# EAGLE schematic Resistor_Resistor (EAGLE 8.3.0), part 15 of 43
## Parts (continued)
R20178  10K  RESISTOR_0201  [0201]
R20179  10K  RESISTOR_0201  [0201]
R20180  10K  RESISTOR_0201  [0201]
R20181  10K  RESISTOR_0201  [0201]
R20182  10K  RESISTOR_0201  [0201]
R20183  10K  RESISTOR_0201  [0201]
R20184  10K  RESISTOR_0201  [0201]
R20185  10K  RESISTOR_0201  [0201]
R20186  10K  RESISTOR_0201  [0201]
R20187  10K  RESISTOR_0201  [0201]
R20188  10K  RESISTOR_0201  [0201]
R20189  10K  RESISTOR_0201  [0201]
R20190  10K  RESISTOR_0201  [0201]
R20191  10K  RESISTOR_0201  [0201]
R20192  10K  RESISTOR_0201  [0201]
R20193  10K  RESISTOR_0201  [0201]
R20194  10K  RESISTOR_0201  [0201]
R20195  10K  RESISTOR_0201  [0201]
R20196  10K  RESISTOR_0201  [0201]
R20197  10K  RESISTOR_0201  [0201]
R20198  10K  RESISTOR_0201  [0201]
R20199  10K  RESISTOR_0201  [0201]
R20200  10K  RESISTOR_0201  [0201]
R20201  10K  RESISTOR_0201  [0201]
R20202  10K  RESISTOR_0201  [0201]
R20203  10K  RESISTOR_0201  [0201]
R20204  10K  RESISTOR_0201  [0201]
R20205  10K  RESISTOR_0201  [0201]
R20206  10K  RESISTOR_0201  [0201]
R20207  10K  RESISTOR_0201  [0201]
R20208  10K  RESISTOR_0201  [0201]
R20209  10K  RESISTOR_0201  [0201]
R20210  10K  RESISTOR_0201  [0201]
R20211  10K  RESISTOR_0201  [0201]
R20212  10K  RESISTOR_0201  [0201]
R20213  10K  RESISTOR_0201  [0201]
R20214  10K  RESISTOR_0201  [0201]
R20215  10K  RESISTOR_0201  [0201]
R20216  10K  RESISTOR_0201  [0201]
R20217  10K  RESISTOR_0201  [0201]
R20218  10K  RESISTOR_0201  [0201]
R20219  10K  RESISTOR_0201  [0201]
R20220  10K  RESISTOR_0201  [0201]
R20221  10K  RESISTOR_0201  [0201]
R20222  10K  RESISTOR_0201  [0201]
R20223  10K  RESISTOR_0201  [0201]
R20224  10K  RESISTOR_0201  [0201]
R20225  10K  RESISTOR_0201  [0201]
R20226  10K  RESISTOR_0201  [0201]
R20227  10K  RESISTOR_0201  [0201]
R20228  10K  RESISTOR_0201  [0201]
R20229  10K  RESISTOR_0201  [0201]
R20230  10K  RESISTOR_0201  [0201]
R20231  10K  RESISTOR_0201  [0201]
R20232  10K  RESISTOR_0201  [0201]
R20233  10K  RESISTOR_0201  [0201]
R20234  10K  RESISTOR_0201  [0201]
R20235  10K  RESISTOR_0201  [0201]
R20236  10K  RESISTOR_0201  [0201]
R20237  10K  RESISTOR_0201  [0201]
R20238  10K  RESISTOR_0201  [0201]
R20239  10K  RESISTOR_0201  [0201]
R20240  10K  RESISTOR_0201  [0201]
R20241  10K  RESISTOR_0201  [0201]
R20242  10K  RESISTOR_0201  [0201]
R20243  10K  RESISTOR_0201  [0201]
R20244  10K  RESISTOR_0201  [0201]
R20245  10K  RESISTOR_0201  [0201]
R20246  10K  RESISTOR_0201  [0201]
R20247  10K  RESISTOR_0201  [0201]
R20248  10K  RESISTOR_0201  [0201]
R20249  10K  RESISTOR_0201  [0201]
R20250  10K  RESISTOR_0201  [0201]
R20251  10K  RESISTOR_0201  [0201]
R20252  10K  RESISTOR_0201  [0201]
R20253  10K  RESISTOR_0201  [0201]
R20254  10K  RESISTOR_0201  [0201]
R20255  10K  RESISTOR_0201  [0201]
R20256  10K  RESISTOR_0201  [0201]
R20257  10K  RESISTOR_0201  [0201]
R20258  10K  RESISTOR_0201  [0201]
R20259  10K  RESISTOR_0201  [0201]
R20260  10K  RESISTOR_0201  [0201]
R20261  10K  RESISTOR_0201  [0201]
R20262  10K  RESISTOR_0201  [0201]
R20263  10K  RESISTOR_0201  [0201]
R20264  10K  RESISTOR_0201  [0201]
R20265  10K  RESISTOR_0201  [0201]
R20266  10K  RESISTOR_0201  [0201]
R20267  10K  RESISTOR_0201  [0201]
R20268  10K  RESISTOR_0201  [0201]
R20269  10K  RESISTOR_0201  [0201]
R20270  10K  RESISTOR_0201  [0201]
R20271  10K  RESISTOR_0201  [0201]
R20272  10K  RESISTOR_0201  [0201]
R20273  10K  RESISTOR_0201  [0201]
R20274  10K  RESISTOR_0201  [0201]
R20275  10K  RESISTOR_0201  [0201]
R20276  10K  RESISTOR_0201  [0201]
R20277  10K  RESISTOR_0201  [0201]
R20278  10K  RESISTOR_0201  [0201]
R20279  10K  RESISTOR_0201  [0201]
R20280  10K  RESISTOR_0201  [0201]
R20281  10K  RESISTOR_0201  [0201]
R20282  10K  RESISTOR_0201  [0201]
R20283  10K  RESISTOR_0201  [0201]
R20284  10K  RESISTOR_0201  [0201]
R20285  10K  RESISTOR_0201  [0201]
R20286  10K  RESISTOR_0201  [0201]
R20287  10K  RESISTOR_0201  [0201]
R20288  10K  RESISTOR_0201  [0201]
R20289  10K  RESISTOR_0201  [0201]
R20290  10K  RESISTOR_0201  [0201]
R20291  10K  RESISTOR_0201  [0201]
R20292  10K  RESISTOR_0201  [0201]
R20293  10K  RESISTOR_0201  [0201]
R20294  10K  RESISTOR_0201  [0201]
R20295  10K  RESISTOR_0201  [0201]
R20296  10K  RESISTOR_0201  [0201]
R20297  10K  RESISTOR_0201  [0201]
R20298  10K  RESISTOR_0201  [0201]
R20299  10K  RESISTOR_0201  [0201]
R20300  10K  RESISTOR_0201  [0201]
R20301  10K  RESISTOR_0201  [0201]
R20302  10K  RESISTOR_0201  [0201]
R20303  10K  RESISTOR_0201  [0201]
R20304  10K  RESISTOR_0201  [0201]
R20305  10K  RESISTOR_0201  [0201]
R20306  10K  RESISTOR_0201  [0201]
R20307  10K  RESISTOR_0201  [0201]
R20308  10K  RESISTOR_0201  [0201]
R20309  10K  RESISTOR_0201  [0201]
R20310  10K  RESISTOR_0201  [0201]
R20311  10K  RESISTOR_0201  [0201]
R20312  10K  RESISTOR_0201  [0201]
R20313  10K  RESISTOR_0201  [0201]
R20314  10K  RESISTOR_0201  [0201]
R20315  10K  RESISTOR_0201  [0201]
R20316  10K  RESISTOR_0201  [0201]
R20317  10K  RESISTOR_0201  [0201]
R20318  10K  RESISTOR_0201  [0201]
R20319  10K  RESISTOR_0201  [0201]
R20320  10K  RESISTOR_0201  [0201]
R20321  10K  RESISTOR_0201  [0201]
R20322  10K  RESISTOR_0201  [0201]
R20323  10K  RESISTOR_0201  [0201]
R20324  10K  RESISTOR_0201  [0201]
R20325  10K  RESISTOR_0201  [0201]
R20326  10K  RESISTOR_0201  [0201]
R20327  10K  RESISTOR_0201  [0201]
R20328  10K  RESISTOR_0201  [0201]
R20329  10K  RESISTOR_0201  [0201]
R20330  10K  RESISTOR_0201  [0201]
R20331  10K  RESISTOR_0201  [0201]
R20332  10K  RESISTOR_0201  [0201]
R20333  10K  RESISTOR_0201  [0201]
R20334  10K  RESISTOR_0201  [0201]
R20335  10K  RESISTOR_0201  [0201]
R20336  10K  RESISTOR_0201  [0201]
R20337  10K  RESISTOR_0201  [0201]
R20338  10K  RESISTOR_0201  [0201]
R20339  10K  RESISTOR_0201  [0201]
R20340  10K  RESISTOR_0201  [0201]
R20341  10K  RESISTOR_0201  [0201]
R20342  10K  RESISTOR_0201  [0201]
R20343  10K  RESISTOR_0201  [0201]
R20344  10K  RESISTOR_0201  [0201]
R20345  10K  RESISTOR_0201  [0201]
R20346  10K  RESISTOR_0201  [0201]
R20347  10K  RESISTOR_0201  [0201]
R20348  10K  RESISTOR_0201  [0201]
R20349  10K  RESISTOR_0201  [0201]
R20350  10K  RESISTOR_0201  [0201]
R20351  10K  RESISTOR_0201  [0201]
R20352  10K  RESISTOR_0201  [0201]
R20353  10K  RESISTOR_0201  [0201]
R20354  10K  RESISTOR_0201  [0201]
R20355  10K  RESISTOR_0201  [0201]
R20356  10K  RESISTOR_0201  [0201]
R20357  10K  RESISTOR_0201  [0201]
R20358  10K  RESISTOR_0201  [0201]
R20359  10K  RESISTOR_0201  [0201]
R20360  10K  RESISTOR_0201  [0201]
R20361  10K  RESISTOR_0201  [0201]
R20362  10K  RESISTOR_0201  [0201]
R20363  10K  RESISTOR_0201  [0201]
R20364  10K  RESISTOR_0201  [0201]
R20365  10K  RESISTOR_0201  [0201]
R20366  10K  RESISTOR_0201  [0201]
R20367  10K  RESISTOR_0201  [0201]
R20368  10K  RESISTOR_0201  [0201]
R20369  10K  RESISTOR_0201  [0201]
R20370  10K  RESISTOR_0201  [0201]
R20371  10K  RESISTOR_0201  [0201]
R20372  10K  RESISTOR_0201  [0201]
R20373  10K  RESISTOR_0201  [0201]
R20374  10K  RESISTOR_0201  [0201]
R20375  10K  RESISTOR_0201  [0201]
R20376  10K  RESISTOR_0201  [0201]
R20377  10K  RESISTOR_0201  [0201]
R20378  10K  RESISTOR_0201  [0201]
R20379  10K  RESISTOR_0201  [0201]
R20380  10K  RESISTOR_0201  [0201]
R20381  10K  RESISTOR_0201  [0201]
R20382  10K  RESISTOR_0201  [0201]
R20383  10K  RESISTOR_0201  [0201]
R20384  10K  RESISTOR_0201  [0201]
R20385  10K  RESISTOR_0201  [0201]
R20386  10K  RESISTOR_0201  [0201]
R20387  10K  RESISTOR_0201  [0201]
R20388  10K  RESISTOR_0201  [0201]
R20389  10K  RESISTOR_0201  [0201]
R20390  10K  RESISTOR_0201  [0201]
R20391  10K  RESISTOR_0201  [0201]
R20392  10K  RESISTOR_0201  [0201]
R20393  10K  RESISTOR_0201  [0201]
R20394  10K  RESISTOR_0201  [0201]
R20395  10K  RESISTOR_0201  [0201]
R20396  10K  RESISTOR_0201  [0201]
R20397  10K  RESISTOR_0201  [0201]
R20398  10K  RESISTOR_0201  [0201]
R20399  10K  RESISTOR_0201  [0201]
R20400  10K  RESISTOR_0201  [0201]
R20401  10K  RESISTOR_0201  [0201]
R20402  10K  RESISTOR_0201  [0201]
R20403  10K  RESISTOR_0201  [0201]
R20404  10K  RESISTOR_0201  [0201]
R20405  10K  RESISTOR_0201  [0201]
R20406  10K  RESISTOR_0201  [0201]
R20407  10K  RESISTOR_0201  [0201]
R20408  10K  RESISTOR_0201  [0201]
R20409  10K  RESISTOR_0201  [0201]
R20410  10K  RESISTOR_0201  [0201]
R20411  10K  RESISTOR_0201  [0201]
R20412  10K  RESISTOR_0201  [0201]
R20413  10K  RESISTOR_0201  [0201]
R20414  10K  RESISTOR_0201  [0201]
R20415  10K  RESISTOR_0201  [0201]
R20416  10K  RESISTOR_0201  [0201]
R20417  10K  RESISTOR_0201  [0201]
R20418  10K  RESISTOR_0201  [0201]
R20419  10K  RESISTOR_0201  [0201]
R20420  10K  RESISTOR_0201  [0201]
R20421  10K  RESISTOR_0201  [0201]
R20422  10K  RESISTOR_0201  [0201]
R20423  10K  RESISTOR_0201  [0201]
R20424  10K  RESISTOR_0201  [0201]
R20425  10K  RESISTOR_0201  [0201]
R20426  10K  RESISTOR_0201  [0201]
R20427  10K  RESISTOR_0201  [0201]
R20428  10K  RESISTOR_0201  [0201]
R20429  10K  RESISTOR_0201  [0201]
R20430  10K  RESISTOR_0201  [0201]
R20431  10K  RESISTOR_0201  [0201]
R20432  10K  RESISTOR_0201  [0201]
R20433  10K  RESISTOR_0201  [0201]
R20434  10K  RESISTOR_0201  [0201]
R20435  10K  RESISTOR_0201  [0201]
R20436  10K  RESISTOR_0201  [0201]
R20437  10K  RESISTOR_0201  [0201]
R20438  10K  RESISTOR_0201  [0201]
R20439  10K  RESISTOR_0201  [0201]
R20440  10K  RESISTOR_0201  [0201]
R20441  10K  RESISTOR_0201  [0201]
R20442  10K  RESISTOR_0201  [0201]
R20443  10K  RESISTOR_0201  [0201]
R20444  10K  RESISTOR_0201  [0201]
R20445  10K  RESISTOR_0201  [0201]
R20446  10K  RESISTOR_0201  [0201]
R20447  10K  RESISTOR_0201  [0201]
R20448  10K  RESISTOR_0201  [0201]
R20449  10K  RESISTOR_0201  [0201]
R20450  10K  RESISTOR_0201  [0201]
R20451  10K  RESISTOR_0201  [0201]
R20452  10K  RESISTOR_0201  [0201]
R20453  10K  RESISTOR_0201  [0201]
R20454  10K  RESISTOR_0201  [0201]
R20455  10K  RESISTOR_0201  [0201]
R20456  10K  RESISTOR_0201  [0201]
R20457  10K  RESISTOR_0201  [0201]
R20458  10K  RESISTOR_0201  [0201]
R20459  10K  RESISTOR_0201  [0201]
R20460  10K  RESISTOR_0201  [0201]
R20461  10K  RESISTOR_0201  [0201]
R20462  10K  RESISTOR_0201  [0201]
R20463  10K  RESISTOR_0201  [0201]
R20464  10K  RESISTOR_0201  [0201]
R20465  10K  RESISTOR_0201  [0201]
R20466  10K  RESISTOR_0201  [0201]
R20467  10K  RESISTOR_0201  [0201]
R20468  10K  RESISTOR_0201  [0201]
R20469  10K  RESISTOR_0201  [0201]
R20470  10K  RESISTOR_0201  [0201]
R20471  10K  RESISTOR_0201  [0201]
R20472  10K  RESISTOR_0201  [0201]
R20473  10K  RESISTOR_0201  [0201]
R20474  10K  RESISTOR_0201  [0201]
R20475  10K  RESISTOR_0201  [0201]
R20476  10K  RESISTOR_0201  [0201]
R20477  10K  RESISTOR_0201  [0201]
R20478  10K  RESISTOR_0201  [0201]
R20479  10K  RESISTOR_0201  [0201]
R20480  10K  RESISTOR_0201  [0201]
R20481  10K  RESISTOR_0201  [0201]
R20482  10K  RESISTOR_0201  [0201]
R20483  10K  RESISTOR_0201  [0201]
R20484  10K  RESISTOR_0201  [0201]
R20485  10K  RESISTOR_0201  [0201]
R20486  10K  RESISTOR_0201  [0201]
R20487  10K  RESISTOR_0201  [0201]
R20488  10K  RESISTOR_0201  [0201]
R20489  10K  RESISTOR_0201  [0201]
R20490  10K  RESISTOR_0201  [0201]
R20491  10K  RESISTOR_0201  [0201]
R20492  10K  RESISTOR_0201  [0201]
R20493  10K  RESISTOR_0201  [0201]
R20494  10K  RESISTOR_0201  [0201]
R20495  10K  RESISTOR_0201  [0201]
R20496  10K  RESISTOR_0201  [0201]
R20497  10K  RESISTOR_0201  [0201]
R20498  10K  RESISTOR_0201  [0201]
R20499  10K  RESISTOR_0201  [0201]
R20500  10K  RESISTOR_0201  [0201]
R20501  10K  RESISTOR_0201  [0201]
R20502  10K  RESISTOR_0201  [0201]
R20503  10K  RESISTOR_0201  [0201]
R20504  10K  RESISTOR_0201  [0201]
R20505  10K  RESISTOR_0201  [0201]
R20506  10K  RESISTOR_0201  [0201]
R20507  10K  RESISTOR_0201  [0201]
R20508  10K  RESISTOR_0201  [0201]
R20509  10K  RESISTOR_0201  [0201]
R20510  10K  RESISTOR_0201  [0201]
R20511  10K  RESISTOR_0201  [0201]
R20512  10K  RESISTOR_0201  [0201]
R20513  10K  RESISTOR_0201  [0201]
R20514  10K  RESISTOR_0201  [0201]
R20515  10K  RESISTOR_0201  [0201]
R20516  10K  RESISTOR_0201  [0201]
R20517  10K  RESISTOR_0201  [0201]
R20518  10K  RESISTOR_0201  [0201]
R20519  10K  RESISTOR_0201  [0201]
R20520  10K  RESISTOR_0201  [0201]
R20521  10K  RESISTOR_0201  [0201]
R20522  10K  RESISTOR_0201  [0201]
R20523  10K  RESISTOR_0201  [0201]
R20524  10K  RESISTOR_0201  [0201]
R20525  10K  RESISTOR_0201  [0201]
R20526  10K  RESISTOR_0201  [0201]
R20527  10K  RESISTOR_0201  [0201]
R20528  10K  RESISTOR_0201  [0201]
R20529  10K  RESISTOR_0201  [0201]
R20530  10K  RESISTOR_0201  [0201]
R20531  10K  RESISTOR_0201  [0201]
R20532  10K  RESISTOR_0201  [0201]
R20533  10K  RESISTOR_0201  [0201]
R20534  10K  RESISTOR_0201  [0201]
R20535  10K  RESISTOR_0201  [0201]
R20536  10K  RESISTOR_0201  [0201]
R20537  10K  RESISTOR_0201  [0201]
R20538  10K  RESISTOR_0201  [0201]
R20539  10K  RESISTOR_0201  [0201]
R20540  10K  RESISTOR_0201  [0201]
R20541  10K  RESISTOR_0201  [0201]
R20542  10K  RESISTOR_0201  [0201]
R20543  10K  RESISTOR_0201  [0201]
R20544  10K  RESISTOR_0201  [0201]
R20545  10K  RESISTOR_0201  [0201]
R20546  10K  RESISTOR_0201  [0201]
R20547  10K  RESISTOR_0201  [0201]
R20548  10K  RESISTOR_0201  [0201]
R20549  10K  RESISTOR_0201  [0201]
R20550  10K  RESISTOR_0201  [0201]
R20551  10K  RESISTOR_0201  [0201]
R20552  10K  RESISTOR_0201  [0201]
R20553  10K  RESISTOR_0201  [0201]
R20554  10K  RESISTOR_0201  [0201]
R20555  10K  RESISTOR_0201  [0201]
R20556  10K  RESISTOR_0201  [0201]
R20557  10K  RESISTOR_0201  [0201]
R20558  10K  RESISTOR_0201  [0201]
R20559  10K  RESISTOR_0201  [0201]
R20560  10K  RESISTOR_0201  [0201]
R20561  10K  RESISTOR_0201  [0201]
R20562  10K  RESISTOR_0201  [0201]
R20563  10K  RESISTOR_0201  [0201]
R20564  10K  RESISTOR_0201  [0201]
R20565  10K  RESISTOR_0201  [0201]
R20566  10K  RESISTOR_0201  [0201]
R20567  10K  RESISTOR_0201  [0201]
R20568  10K  RESISTOR_0201  [0201]
R20569  10K  RESISTOR_0201  [0201]
R20570  10K  RESISTOR_0201  [0201]
R20571  10K  RESISTOR_0201  [0201]
R20572  10K  RESISTOR_0201  [0201]
R20573  10K  RESISTOR_0201  [0201]
R20574  10K  RESISTOR_0201  [0201]
R20575  10K  RESISTOR_0201  [0201]
R20576  10K  RESISTOR_0201  [0201]
R20577  10K  RESISTOR_0201  [0201]
R20578  10K  RESISTOR_0201  [0201]
R20579  10K  RESISTOR_0201  [0201]
R20580  10K  RESISTOR_0201  [0201]
R20581  10K  RESISTOR_0201  [0201]
R20582  10K  RESISTOR_0201  [0201]
R20583  10K  RESISTOR_0201  [0201]
R20584  10K  RESISTOR_0201  [0201]
R20585  10K  RESISTOR_0201  [0201]
R20586  10K  RESISTOR_0201  [0201]
R20587  10K  RESISTOR_0201  [0201]
R20588  10K  RESISTOR_0201  [0201]
R20589  10K  RESISTOR_0201  [0201]
R20590  10K  RESISTOR_0201  [0201]
R20591  10K  RESISTOR_0201  [0201]
R20592  10K  RESISTOR_0201  [0201]
R20593  10K  RESISTOR_0201  [0201]
R20594  10K  RESISTOR_0201  [0201]
R20595  10K  RESISTOR_0201  [0201]
R20596  10K  RESISTOR_0201  [0201]
R20597  10K  RESISTOR_0201  [0201]
R20598  10K  RESISTOR_0201  [0201]
R20599  10K  RESISTOR_0201  [0201]
R20600  10K  RESISTOR_0201  [0201]
R20601  10K  RESISTOR_0201  [0201]
R20602  10K  RESISTOR_0201  [0201]
R20603  10K  RESISTOR_0201  [0201]
R20604  10K  RESISTOR_0201  [0201]
R20605  10K  RESISTOR_0201  [0201]
R20606  10K  RESISTOR_0201  [0201]
R20607  10K  RESISTOR_0201  [0201]
R20608  10K  RESISTOR_0201  [0201]
R20609  10K  RESISTOR_0201  [0201]
R20610  10K  RESISTOR_0201  [0201]
R20611  10K  RESISTOR_0201  [0201]
R20612  10K  RESISTOR_0201  [0201]
R20613  10K  RESISTOR_0201  [0201]
R20614  10K  RESISTOR_0201  [0201]
R20615  10K  RESISTOR_0201  [0201]
R20616  10K  RESISTOR_0201  [0201]
R20617  10K  RESISTOR_0201  [0201]
R20618  10K  RESISTOR_0201  [0201]
R20619  10K  RESISTOR_0201  [0201]
R20620  10K  RESISTOR_0201  [0201]
R20621  10K  RESISTOR_0201  [0201]
R20622  10K  RESISTOR_0201  [0201]
R20623  10K  RESISTOR_0201  [0201]
R20624  10K  RESISTOR_0201  [0201]
R20625  10K  RESISTOR_0201  [0201]
R20626  10K  RESISTOR_0201  [0201]
R20627  10K  RESISTOR_0201  [0201]
R20628  10K  RESISTOR_0201  [0201]
R20629  10K  RESISTOR_0201  [0201]
R20630  10K  RESISTOR_0201  [0201]
R20631  10K  RESISTOR_0201  [0201]
R20632  10K  RESISTOR_0201  [0201]
R20633  10K  RESISTOR_0201  [0201]
R20634  10K  RESISTOR_0201  [0201]
R20635  10K  RESISTOR_0201  [0201]
R20636  10K  RESISTOR_0201  [0201]
R20637  10K  RESISTOR_0201  [0201]
R20638  10K  RESISTOR_0201  [0201]
R20639  10K  RESISTOR_0201  [0201]
R20640  10K  RESISTOR_0201  [0201]
R20641  10K  RESISTOR_0201  [0201]
R20642  10K  RESISTOR_0201  [0201]
R20643  10K  RESISTOR_0201  [0201]
R20644  10K  RESISTOR_0201  [0201]
R20645  10K  RESISTOR_0201  [0201]
R20646  10K  RESISTOR_0201  [0201]
R20647  10K  RESISTOR_0201  [0201]
R20648  10K  RESISTOR_0201  [0201]
R20649  10K  RESISTOR_0201  [0201]
R20650  10K  RESISTOR_0201  [0201]
R20651  10K  RESISTOR_0201  [0201]
R20652  10K  RESISTOR_0201  [0201]
R20653  10K  RESISTOR_0201  [0201]
R20654  10K  RESISTOR_0201  [0201]
R20655  10K  RESISTOR_0201  [0201]
R20656  10K  RESISTOR_0201  [0201]
R20657  10K  RESISTOR_0201  [0201]
R20658  10K  RESISTOR_0201  [0201]
R20659  10K  RESISTOR_0201  [0201]
R20660  10K  RESISTOR_0201  [0201]
R20661  10K  RESISTOR_0201  [0201]
R20662  10K  RESISTOR_0201  [0201]
R20663  10K  RESISTOR_0201  [0201]
R20664  10K  RESISTOR_0201  [0201]
R20665  10K  RESISTOR_0201  [0201]
R20666  10K  RESISTOR_0201  [0201]
R20667  10K  RESISTOR_0201  [0201]
R20668  10K  RESISTOR_0201  [0201]
R20669  10K  RESISTOR_0201  [0201]
R20670  10K  RESISTOR_0201  [0201]
R20671  10K  RESISTOR_0201  [0201]
R20672  10K  RESISTOR_0201  [0201]
R20673  10K  RESISTOR_0201  [0201]
R20674  10K  RESISTOR_0201  [0201]
R20675  10K  RESISTOR_0201  [0201]
R20676  10K  RESISTOR_0201  [0201]
R20677  10K  RESISTOR_0201  [0201]
R20678  10K  RESISTOR_0201  [0201]
R20679  10K  RESISTOR_0201  [0201]
R20680  10K  RESISTOR_0201  [0201]
R20681  10K  RESISTOR_0201  [0201]
R20682  10K  RESISTOR_0201  [0201]
R20683  10K  RESISTOR_0201  [0201]
R20684  10K  RESISTOR_0201  [0201]
R20685  10K  RESISTOR_0201  [0201]
R20686  10K  RESISTOR_0201  [0201]
R20687  10K  RESISTOR_0201  [0201]
R20688  10K  RESISTOR_0201  [0201]
R20689  10K  RESISTOR_0201  [0201]
R20690  10K  RESISTOR_0201  [0201]
R20691  10K  RESISTOR_0201  [0201]
R20692  10K  RESISTOR_0201  [0201]
R20693  10K  RESISTOR_0201  [0201]
R20694  10K  RESISTOR_0201  [0201]
R20695  10K  RESISTOR_0201  [0201]
R20696  10K  RESISTOR_0201  [0201]
R20697  10K  RESISTOR_0201  [0201]
R20698  10K  RESISTOR_0201  [0201]
R20699  10K  RESISTOR_0201  [0201]
R20700  10K  RESISTOR_0201  [0201]
R20701  10K  RESISTOR_0201  [0201]
R20702  10K  RESISTOR_0201  [0201]
R20703  10K  RESISTOR_0201  [0201]
R20704  10K  RESISTOR_0201  [0201]
R20705  10K  RESISTOR_0201  [0201]
R20706  10K  RESISTOR_0201  [0201]
R20707  10K  RESISTOR_0201  [0201]
R20708  10K  RESISTOR_0201  [0201]
R20709  10K  RESISTOR_0201  [0201]
R20710  10K  RESISTOR_0201  [0201]
R20711  10K  RESISTOR_0201  [0201]
R20712  10K  RESISTOR_0201  [0201]
R20713  10K  RESISTOR_0201  [0201]
R20714  10K  RESISTOR_0201  [0201]
R20715  10K  RESISTOR_0201  [0201]
R20716  10K  RESISTOR_0201  [0201]
R20717  10K  RESISTOR_0201  [0201]
R20718  10K  RESISTOR_0201  [0201]
R20719  10K  RESISTOR_0201  [0201]
R20720  10K  RESISTOR_0201  [0201]
R20721  10K  RESISTOR_0201  [0201]
R20722  10K  RESISTOR_0201  [0201]
R20723  10K  RESISTOR_0201  [0201]
R20724  10K  RESISTOR_0201  [0201]
R20725  10K  RESISTOR_0201  [0201]
R20726  10K  RESISTOR_0201  [0201]
R20727  10K  RESISTOR_0201  [0201]
R20728  10K  RESISTOR_0201  [0201]
R20729  10K  RESISTOR_0201  [0201]
R20730  10K  RESISTOR_0201  [0201]
R20731  10K  RESISTOR_0201  [0201]
R20732  10K  RESISTOR_0201  [0201]
R20733  10K  RESISTOR_0201  [0201]
R20734  10K  RESISTOR_0201  [0201]
R20735  10K  RESISTOR_0201  [0201]
R20736  10K  RESISTOR_0201  [0201]
R20737  10K  RESISTOR_0201  [0201]
R20738  10K  RESISTOR_0201  [0201]
R20739  10K  RESISTOR_0201  [0201]
R20740  10K  RESISTOR_0201  [0201]
R20741  10K  RESISTOR_0201  [0201]
R20742  10K  RESISTOR_0201  [0201]
R20743  10K  RESISTOR_0201  [0201]
R20744  10K  RESISTOR_0201  [0201]
R20745  10K  RESISTOR_0201  [0201]
R20746  10K  RESISTOR_0201  [0201]
R20747  10K  RESISTOR_0201  [0201]
R20748  10K  RESISTOR_0201  [0201]
R20749  10K  RESISTOR_0201  [0201]
R20750  10K  RESISTOR_0201  [0201]
R20751  10K  RESISTOR_0201  [0201]
R20752  10K  RESISTOR_0201  [0201]
R20753  10K  RESISTOR_0201  [0201]
R20754  10K  RESISTOR_0201  [0201]
R20755  10K  RESISTOR_0201  [0201]
R20756  10K  RESISTOR_0201  [0201]
R20757  10K  RESISTOR_0201  [0201]
R20758  10K  RESISTOR_0201  [0201]
R20759  10K  RESISTOR_0201  [0201]
R20760  10K  RESISTOR_0201  [0201]
R20761  10K  RESISTOR_0201  [0201]
R20762  10K  RESISTOR_0201  [0201]
R20763  10K  RESISTOR_0201  [0201]
R20764  10K  RESISTOR_0201  [0201]
R20765  10K  RESISTOR_0201  [0201]
R20766  10K  RESISTOR_0201  [0201]
R20767  10K  RESISTOR_0201  [0201]
R20768  10K  RESISTOR_0201  [0201]
R20769  10K  RESISTOR_0201  [0201]
R20770  10K  RESISTOR_0201  [0201]
R20771  10K  RESISTOR_0201  [0201]
R20772  10K  RESISTOR_0201  [0201]
R20773  10K  RESISTOR_0201  [0201]
R20774  10K  RESISTOR_0201  [0201]
R20775  10K  RESISTOR_0201  [0201]
R20776  10K  RESISTOR_0201  [0201]
R20777  10K  RESISTOR_0201  [0201]
R20778  10K  RESISTOR_0201  [0201]
R20779  10K  RESISTOR_0201  [0201]
R20780  10K  RESISTOR_0201  [0201]
R20781  10K  RESISTOR_0201  [0201]
R20782  10K  RESISTOR_0201  [0201]
R20783  10K  RESISTOR_0201  [0201]
R20784  10K  RESISTOR_0201  [0201]
R20785  10K  RESISTOR_0201  [0201]
R20786  10K  RESISTOR_0201  [0201]
R20787  10K  RESISTOR_0201  [0201]
R20788  10K  RESISTOR_0201  [0201]
R20789  10K  RESISTOR_0201  [0201]
R20790  10K  RESISTOR_0201  [0201]
R20791  10K  RESISTOR_0201  [0201]
R20792  10K  RESISTOR_0201  [0201]
R20793  10K  RESISTOR_0201  [0201]
R20794  10K  RESISTOR_0201  [0201]
R20795  10K  RESISTOR_0201  [0201]
R20796  10K  RESISTOR_0201  [0201]
R20797  10K  RESISTOR_0201  [0201]
R20798  10K  RESISTOR_0201  [0201]
R20799  10K  RESISTOR_0201  [0201]
R20800  10K  RESISTOR_0201  [0201]
R20801  10K  RESISTOR_0201  [0201]
R20802  10K  RESISTOR_0201  [0201]
R20803  10K  RESISTOR_0201  [0201]
R20804  10K  RESISTOR_0201  [0201]
R20805  10K  RESISTOR_0201  [0201]
R20806  10K  RESISTOR_0201  [0201]
R20807  10K  RESISTOR_0201  [0201]
R20808  10K  RESISTOR_0201  [0201]
R20809  10K  RESISTOR_0201  [0201]
R20810  10K  RESISTOR_0201  [0201]
R20811  10K  RESISTOR_0201  [0201]
R20812  10K  RESISTOR_0201  [0201]
R20813  10K  RESISTOR_0201  [0201]
R20814  10K  RESISTOR_0201  [0201]
R20815  10K  RESISTOR_0201  [0201]
R20816  10K  RESISTOR_0201  [0201]
R20817  10K  RESISTOR_0201  [0201]
R20818  10K  RESISTOR_0201  [0201]
R20819  10K  RESISTOR_0201  [0201]
R20820  10K  RESISTOR_0201  [0201]
R20821  10K  RESISTOR_0201  [0201]
R20822  10K  RESISTOR_0201  [0201]
R20823  10K  RESISTOR_0201  [0201]
R20824  10K  RESISTOR_0201  [0201]
R20825  10K  RESISTOR_0201  [0201]
R20826  10K  RESISTOR_0201  [0201]
R20827  10K  RESISTOR_0201  [0201]
R20828  10K  RESISTOR_0201  [0201]
R20829  10K  RESISTOR_0201  [0201]
R20830  10K  RESISTOR_0201  [0201]
R20831  10K  RESISTOR_0201  [0201]
R20832  10K  RESISTOR_0201  [0201]
R20833  10K  RESISTOR_0201  [0201]
R20834  10K  RESISTOR_0201  [0201]
R20835  10K  RESISTOR_0201  [0201]
R20836  10K  RESISTOR_0201  [0201]
R20837  10K  RESISTOR_0201  [0201]
R20838  10K  RESISTOR_0201  [0201]
R20839  10K  RESISTOR_0201  [0201]
R20840  10K  RESISTOR_0201  [0201]
R20841  10K  RESISTOR_0201  [0201]
R20842  10K  RESISTOR_0201  [0201]
R20843  10K  RESISTOR_0201  [0201]
R20844  10K  RESISTOR_0201  [0201]
R20845  10K  RESISTOR_0201  [0201]
R20846  10K  RESISTOR_0201  [0201]
R20847  10K  RESISTOR_0201  [0201]
R20848  10K  RESISTOR_0201  [0201]
R20849  10K  RESISTOR_0201  [0201]
R20850  10K  RESISTOR_0201  [0201]
R20851  10K  RESISTOR_0201  [0201]
R20852  10K  RESISTOR_0201  [0201]
R20853  10K  RESISTOR_0201  [0201]
R20854  10K  RESISTOR_0201  [0201]
R20855  10K  RESISTOR_0201  [0201]
R20856  10K  RESISTOR_0201  [0201]
R20857  10K  RESISTOR_0201  [0201]
R20858  10K  RESISTOR_0201  [0201]
R20859  10K  RESISTOR_0201  [0201]
R20860  10K  RESISTOR_0201  [0201]
R20861  10K  RESISTOR_0201  [0201]
R20862  10K  RESISTOR_0201  [0201]
R20863  10K  RESISTOR_0201  [0201]
R20864  10K  RESISTOR_0201  [0201]
R20865  10K  RESISTOR_0201  [0201]
R20866  10K  RESISTOR_0201  [0201]
R20867  10K  RESISTOR_0201  [0201]
R20868  10K  RESISTOR_0201  [0201]
R20869  10K  RESISTOR_0201  [0201]
R20870  10K  RESISTOR_0201  [0201]
R20871  10K  RESISTOR_0201  [0201]
R20872  10K  RESISTOR_0201  [0201]
R20873  10K  RESISTOR_0201  [0201]
R20874  10K  RESISTOR_0201  [0201]
R20875  10K  RESISTOR_0201  [0201]
R20876  10K  RESISTOR_0201  [0201]
R20877  10K  RESISTOR_0201  [0201]
R20878  10K  RESISTOR_0201  [0201]
R20879  10K  RESISTOR_0201  [0201]
R20880  10K  RESISTOR_0201  [0201]
R20881  10K  RESISTOR_0201  [0201]
R20882  10K  RESISTOR_0201  [0201]
R20883  10K  RESISTOR_0201  [0201]
R20884  10K  RESISTOR_0201  [0201]
R20885  10K  RESISTOR_0201  [0201]
R20886  10K  RESISTOR_0201  [0201]
R20887  10K  RESISTOR_0201  [0201]
R20888  10K  RESISTOR_0201  [0201]
R20889  10K  RESISTOR_0201  [0201]
R20890  10K  RESISTOR_0201  [0201]
R20891  10K  RESISTOR_0201  [0201]
R20892  10K  RESISTOR_0201  [0201]
R20893  10K  RESISTOR_0201  [0201]
R20894  10K  RESISTOR_0201  [0201]
R20895  10K  RESISTOR_0201  [0201]
R20896  10K  RESISTOR_0201  [0201]
R20897  10K  RESISTOR_0201  [0201]
R20898  10K  RESISTOR_0201  [0201]
R20899  10K  RESISTOR_0201  [0201]
R20900  10K  RESISTOR_0201  [0201]
R20901  10K  RESISTOR_0201  [0201]
R20902  10K  RESISTOR_0201  [0201]
R20903  10K  RESISTOR_0201  [0201]
R20904  10K  RESISTOR_0201  [0201]
R20905  10K  RESISTOR_0201  [0201]
R20906  10K  RESISTOR_0201  [0201]
R20907  10K  RESISTOR_0201  [0201]
R20908  10K  RESISTOR_0201  [0201]
R20909  10K  RESISTOR_0201  [0201]
R20910  10K  RESISTOR_0201  [0201]
R20911  10K  RESISTOR_0201  [0201]
R20912  10K  RESISTOR_0201  [0201]
R20913  10K  RESISTOR_0201  [0201]
R20914  10K  RESISTOR_0201  [0201]
R20915  10K  RESISTOR_0201  [0201]
R20916  10K  RESISTOR_0201  [0201]
R20917  10K  RESISTOR_0201  [0201]
R20918  10K  RESISTOR_0201  [0201]
R20919  10K  RESISTOR_0201  [0201]
R20920  10K  RESISTOR_0201  [0201]
R20921  10K  RESISTOR_0201  [0201]
R20922  10K  RESISTOR_0201  [0201]
R20923  10K  RESISTOR_0201  [0201]
R20924  10K  RESISTOR_0201  [0201]
R20925  10K  RESISTOR_0201  [0201]
R20926  10K  RESISTOR_0201  [0201]
R20927  10K  RESISTOR_0201  [0201]
R20928  10K  RESISTOR_0201  [0201]
R20929  10K  RESISTOR_0201  [0201]
R20930  10K  RESISTOR_0201  [0201]
R20931  10K  RESISTOR_0201  [0201]
R20932  10K  RESISTOR_0201  [0201]
R20933  10K  RESISTOR_0201  [0201]
R20934  10K  RESISTOR_0201  [0201]
R20935  10K  RESISTOR_0201  [0201]
R20936  10K  RESISTOR_0201  [0201]
R20937  10K  RESISTOR_0201  [0201]
R20938  10K  RESISTOR_0201  [0201]
R20939  10K  RESISTOR_0201  [0201]
R20940  10K  RESISTOR_0201  [0201]
R20941  10K  RESISTOR_0201  [0201]
R20942  10K  RESISTOR_0201  [0201]
R20943  10K  RESISTOR_0201  [0201]
R20944  10K  RESISTOR_0201  [0201]
R20945  10K  RESISTOR_0201  [0201]
R20946  10K  RESISTOR_0201  [0201]
R20947  10K  RESISTOR_0201  [0201]
R20948  10K  RESISTOR_0201  [0201]
R20949  10K  RESISTOR_0201  [0201]
R20950  10K  RESISTOR_0201  [0201]
R20951  10K  RESISTOR_0201  [0201]
R20952  10K  RESISTOR_0201  [0201]
R20953  10K  RESISTOR_0201  [0201]
R20954  10K  RESISTOR_0201  [0201]
R20955  10K  RESISTOR_0201  [0201]
R20956  10K  RESISTOR_0201  [0201]
R20957  10K  RESISTOR_0201  [0201]
R20958  10K  RESISTOR_0201  [0201]
R20959  10K  RESISTOR_0201  [0201]
R20960  10K  RESISTOR_0201  [0201]
R20961  10K  RESISTOR_0201  [0201]
R20962  10K  RESISTOR_0201  [0201]
R20963  10K  RESISTOR_0201  [0201]
R20964  10K  RESISTOR_0201  [0201]
R20965  10K  RESISTOR_0201  [0201]
R20966  10K  RESISTOR_0201  [0201]
R20967  10K  RESISTOR_0201  [0201]
R20968  10K  RESISTOR_0201  [0201]
R20969  10K  RESISTOR_0201  [0201]
R20970  10K  RESISTOR_0201  [0201]
R20971  10K  RESISTOR_0201  [0201]
R20972  10K  RESISTOR_0201  [0201]
R20973  10K  RESISTOR_0201  [0201]
R20974  10K  RESISTOR_0201  [0201]
R20975  10K  RESISTOR_0201  [0201]
R20976  10K  RESISTOR_0201  [0201]
R20977  10K  RESISTOR_0201  [0201]
R20978  10K  RESISTOR_0201  [0201]
R20979  10K  RESISTOR_0201  [0201]
R20980  10K  RESISTOR_0201  [0201]
R20981  10K  RESISTOR_0201  [0201]
R20982  10K  RESISTOR_0201  [0201]
R20983  10K  RESISTOR_0201  [0201]
R20984  10K  RESISTOR_0201  [0201]
R20985  10K  RESISTOR_0201  [0201]
R20986  10K  RESISTOR_0201  [0201]
R20987  10K  RESISTOR_0201  [0201]
R20988  10K  RESISTOR_0201  [0201]
R20989  10K  RESISTOR_0201  [0201]
R20990  10K  RESISTOR_0201  [0201]
R20991  10K  RESISTOR_0201  [0201]
R20992  10K  RESISTOR_0201  [0201]
R20993  10K  RESISTOR_0201  [0201]
R20994  10K  RESISTOR_0201  [0201]
R20995  10K  RESISTOR_0201  [0201]
R20996  10K  RESISTOR_0201  [0201]
R20997  10K  RESISTOR_0201  [0201]
R20998  10K  RESISTOR_0201  [0201]
R20999  10K  RESISTOR_0201  [0201]
R21000  10K  RESISTOR_0201  [0201]
R21001  10K  RESISTOR_0201  [0201]
R21002  10K  RESISTOR_0201  [0201]
R21003  10K  RESISTOR_0201  [0201]
R21004  10K  RESISTOR_0201  [0201]
R21005  10K  RESISTOR_0201  [0201]
R21006  10K  RESISTOR_0201  [0201]
R21007  10K  RESISTOR_0201  [0201]
R21008  10K  RESISTOR_0201  [0201]
R21009  10K  RESISTOR_0201  [0201]
R21010  10K  RESISTOR_0201  [0201]
R21011  10K  RESISTOR_0201  [0201]
R21012  10K  RESISTOR_0201  [0201]
R21013  10K  RESISTOR_0201  [0201]
R21014  10K  RESISTOR_0201  [0201]
R21015  10K  RESISTOR_0201  [0201]
R21016  10K  RESISTOR_0201  [0201]
R21017  10K  RESISTOR_0201  [0201]
R21018  10K  RESISTOR_0201  [0201]
R21019  10K  RESISTOR_0201  [0201]
R21020  10K  RESISTOR_0201  [0201]
R21021  10K  RESISTOR_0201  [0201]
R21022  10K  RESISTOR_0201  [0201]
R21023  10K  RESISTOR_0201  [0201]
R21024  10K  RESISTOR_0201  [0201]
R21025  10K  RESISTOR_0201  [0201]
R21026  10K  RESISTOR_0201  [0201]
R21027  10K  RESISTOR_0201  [0201]
R21028  10K  RESISTOR_0201  [0201]
R21029  10K  RESISTOR_0201  [0201]
R21030  10K  RESISTOR_0201  [0201]
R21031  10K  RESISTOR_0201  [0201]
R21032  10K  RESISTOR_0201  [0201]
R21033  10K  RESISTOR_0201  [0201]
R21034  10K  RESISTOR_0201  [0201]
R21035  10K  RESISTOR_0201  [0201]
R21036  10K  RESISTOR_0201  [0201]
R21037  10K  RESISTOR_0201  [0201]
R21038  10K  RESISTOR_0201  [0201]
R21039  10K  RESISTOR_0201  [0201]
R21040  10K  RESISTOR_0201  [0201]
R21041  10K  RESISTOR_0201  [0201]
R21042  10K  RESISTOR_0201  [0201]
R21043  10K  RESISTOR_0201  [0201]
R21044  10K  RESISTOR_0201  [0201]
R21045  10K  RESISTOR_0201  [0201]
R21046  10K  RESISTOR_0201  [0201]
R21047  10K  RESISTOR_0201  [0201]
R21048  10K  RESISTOR_0201  [0201]
R21049  10K  RESISTOR_0201  [0201]
R21050  10K  RESISTOR_0201  [0201]
R21051  10K  RESISTOR_0201  [0201]
R21052  10K  RESISTOR_0201  [0201]
R21053  10K  RESISTOR_0201  [0201]
R21054  10K  RESISTOR_0201  [0201]
R21055  10K  RESISTOR_0201  [0201]
R21056  10K  RESISTOR_0201  [0201]
R21057  10K  RESISTOR_0201  [0201]
R21058  10K  RESISTOR_0201  [0201]
R21059  10K  RESISTOR_0201  [0201]
R21060  10K  RESISTOR_0201  [0201]
R21061  10K  RESISTOR_0201  [0201]
R21062  10K  RESISTOR_0201  [0201]
R21063  10K  RESISTOR_0201  [0201]
R21064  10K  RESISTOR_0201  [0201]
R21065  10K  RESISTOR_0201  [0201]
R21066  10K  RESISTOR_0201  [0201]
R21067  10K  RESISTOR_0201  [0201]
R21068  10K  RESISTOR_0201  [0201]
R21069  10K  RESISTOR_0201  [0201]
R21070  10K  RESISTOR_0201  [0201]
R21071  10K  RESISTOR_0201  [0201]
R21072  10K  RESISTOR_0201  [0201]
R21073  10K  RESISTOR_0201  [0201]
R21074  10K  RESISTOR_0201  [0201]
R21075  10K  RESISTOR_0201  [0201]
R21076  10K  RESISTOR_0201  [0201]
R21077  10K  RESISTOR_0201  [0201]
R21078  10K  RESISTOR_0201  [0201]
R21079  10K  RESISTOR_0201  [0201]
R21080  10K  RESISTOR_0201  [0201]
R21081  10K  RESISTOR_0201  [0201]
R21082  10K  RESISTOR_0201  [0201]
R21083  10K  RESISTOR_0201  [0201]
R21084  10K  RESISTOR_0201  [0201]
R21085  10K  RESISTOR_0201  [0201]
R21086  10K  RESISTOR_0201  [0201]
R21087  10K  RESISTOR_0201  [0201]
R21088  10K  RESISTOR_0201  [0201]
R21089  10K  RESISTOR_0201  [0201]
R21090  10K  RESISTOR_0201  [0201]
R21091  10K  RESISTOR_0201  [0201]
R21092  10K  RESISTOR_0201  [0201]
R21093  10K  RESISTOR_0201  [0201]
R21094  10K  RESISTOR_0201  [0201]
R21095  10K  RESISTOR_0201  [0201]
R21096  10K  RESISTOR_0201  [0201]
R21097  10K  RESISTOR_0201  [0201]
R21098  10K  RESISTOR_0201  [0201]
R21099  10K  RESISTOR_0201  [0201]
R21100  10K  RESISTOR_0201  [0201]
R21101  10K  RESISTOR_0201  [0201]
R21102  10K  RESISTOR_0201  [0201]
R21103  10K  RESISTOR_0201  [0201]
R21104  10K  RESISTOR_0201  [0201]
R21105  10K  RESISTOR_0201  [0201]
R21106  10K  RESISTOR_0201  [0201]
R21107  10K  RESISTOR_0201  [0201]
R21108  10K  RESISTOR_0201  [0201]
R21109  10K  RESISTOR_0201  [0201]
R21110  10K  RESISTOR_0201  [0201]
R21111  10K  RESISTOR_0201  [0201]
R21112  10K  RESISTOR_0201  [0201]
R21113  10K  RESISTOR_0201  [0201]
R21114  10K  RESISTOR_0201  [0201]
R21115  10K  RESISTOR_0201  [0201]
R21116  10K  RESISTOR_0201  [0201]
R21117  10K  RESISTOR_0201  [0201]
R21118  10K  RESISTOR_0201  [0201]
R21119  10K  RESISTOR_0201  [0201]
R21120  10K  RESISTOR_0201  [0201]
R21121  10K  RESISTOR_0201  [0201]
R21122  10K  RESISTOR_0201  [0201]
R21123  10K  RESISTOR_0201  [0201]
R21124  10K  RESISTOR_0201  [0201]
R21125  10K  RESISTOR_0201  [0201]
R21126  10K  RESISTOR_0201  [0201]
R21127  10K  RESISTOR_0201  [0201]
R21128  10K  RESISTOR_0201  [0201]
R21129  10K  RESISTOR_0201  [0201]
R21130  10K  RESISTOR_0201  [0201]
R21131  10K  RESISTOR_0201  [0201]
R21132  10K  RESISTOR_0201  [0201]
R21133  10K  RESISTOR_0201  [0201]
R21134  10K  RESISTOR_0201  [0201]
R21135  10K  RESISTOR_0201  [0201]
R21136  10K  RESISTOR_0201  [0201]
R21137  10K  RESISTOR_0201  [0201]
R21138  10K  RESISTOR_0201  [0201]
R21139  10K  RESISTOR_0201  [0201]
R21140  10K  RESISTOR_0201  [0201]
R21141  10K  RESISTOR_0201  [0201]
R21142  10K  RESISTOR_0201  [0201]
R21143  10K  RESISTOR_0201  [0201]
R21144  10K  RESISTOR_0201  [0201]
R21145  10K  RESISTOR_0201  [0201]
R21146  10K  RESISTOR_0201  [0201]
R21147  10K  RESISTOR_0201  [0201]
R21148  10K  RESISTOR_0201  [0201]
R21149  10K  RESISTOR_0201  [0201]
R21150  10K  RESISTOR_0201  [0201]
R21151  10K  RESISTOR_0201  [0201]
R21152  10K  RESISTOR_0201  [0201]
R21153  10K  RESISTOR_0201  [0201]
R21154  10K  RESISTOR_0201  [0201]
R21155  10K  RESISTOR_0201  [0201]
R21156  10K  RESISTOR_0201  [0201]
R21157  10K  RESISTOR_0201  [0201]
R21158  10K  RESISTOR_0201  [0201]
R21159  10K  RESISTOR_0201  [0201]
R21160  10K  RESISTOR_0201  [0201]
R21161  10K  RESISTOR_0201  [0201]
R21162  10K  RESISTOR_0201  [0201]
R21163  10K  RESISTOR_0201  [0201]
R21164  10K  RESISTOR_0201  [0201]
R21165  10K  RESISTOR_0201  [0201]
R21166  10K  RESISTOR_0201  [0201]
R21167  10K  RESISTOR_0201  [0201]
R21168  10K  RESISTOR_0201  [0201]
R21169  10K  RESISTOR_0201  [0201]
R21170  10K  RESISTOR_0201  [0201]
R21171  10K  RESISTOR_0201  [0201]
R21172  10K  RESISTOR_0201  [0201]
R21173  10K  RESISTOR_0201  [0201]
R21174  10K  RESISTOR_0201  [0201]
R21175  10K  RESISTOR_0201  [0201]
R21176  10K  RESISTOR_0201  [0201]
R21177  10K  RESISTOR_0201  [0201]
R21178  10K  RESISTOR_0201  [0201]
R21179  10K  RESISTOR_0201  [0201]
R21180  10K  RESISTOR_0201  [0201]
R21181  10K  RESISTOR_0201  [0201]
R21182  10K  RESISTOR_0201  [0201]
R21183  10K  RESISTOR_0201  [0201]
R21184  10K  RESISTOR_0201  [0201]
R21185  10K  RESISTOR_0201  [0201]
R21186  10K  RESISTOR_0201  [0201]
R21187  10K  RESISTOR_0201  [0201]
R21188  10K  RESISTOR_0201  [0201]
R21189  10K  RESISTOR_0201  [0201]
R21190  10K  RESISTOR_0201  [0201]
R21191  10K  RESISTOR_0201  [0201]
R21192  10K  RESISTOR_0201  [0201]
R21193  10K  RESISTOR_0201  [0201]
R21194  10K  RESISTOR_0201  [0201]
R21195  10K  RESISTOR_0201  [0201]
R21196  10K  RESISTOR_0201  [0201]
R21197  10K  RESISTOR_0201  [0201]
R21198  10K  RESISTOR_0201  [0201]
R21199  10K  RESISTOR_0201  [0201]
R21200  10K  RESISTOR_0201  [0201]
R21201  10K  RESISTOR_0201  [0201]
R21202  10K  RESISTOR_0201  [0201]
R21203  10K  RESISTOR_0201  [0201]
R21204  10K  RESISTOR_0201  [0201]
R21205  10K  RESISTOR_0201  [0201]
R21206  10K  RESISTOR_0201  [0201]
R21207  10K  RESISTOR_0201  [0201]
R21208  10K  RESISTOR_0201  [0201]
R21209  10K  RESISTOR_0201  [0201]
R21210  10K  RESISTOR_0201  [0201]
R21211  10K  RESISTOR_0201  [0201]
R21212  10K  RESISTOR_0201  [0201]
R21213  10K  RESISTOR_0201  [0201]
R21214  10K  RESISTOR_0201  [0201]
R21215  10K  RESISTOR_0201  [0201]
R21216  10K  RESISTOR_0201  [0201]
R21217  10K  RESISTOR_0201  [0201]
R21218  10K  RESISTOR_0201  [0201]
R21219  10K  RESISTOR_0201  [0201]
R21220  10K  RESISTOR_0201  [0201]
R21221  10K  RESISTOR_0201  [0201]
R21222  10K  RESISTOR_0201  [0201]
R21223  10K  RESISTOR_0201  [0201]
R21224  10K  RESISTOR_0201  [0201]
R21225  10K  RESISTOR_0201  [0201]
R21226  10K  RESISTOR_0201  [0201]
R21227  10K  RESISTOR_0201  [0201]
R21228  10K  RESISTOR_0201  [0201]
R21229  10K  RESISTOR_0201  [0201]
R21230  10K  RESISTOR_0201  [0201]
R21231  10K  RESISTOR_0201  [0201]
R21232  10K  RESISTOR_0201  [0201]
R21233  10K  RESISTOR_0201  [0201]
R21234  10K  RESISTOR_0201  [0201]
R21235  10K  RESISTOR_0201  [0201]
R21236  10K  RESISTOR_0201  [0201]
R21237  10K  RESISTOR_0201  [0201]
R21238  10K  RESISTOR_0201  [0201]
R21239  10K  RESISTOR_0201  [0201]
R21240  10K  RESISTOR_0201  [0201]
R21241  10K  RESISTOR_0201  [0201]
R21242  10K  RESISTOR_0201  [0201]
R21243  10K  RESISTOR_0201  [0201]
R21244  10K  RESISTOR_0201  [0201]
R21245  10K  RESISTOR_0201  [0201]
R21246  10K  RESISTOR_0201  [0201]
R21247  10K  RESISTOR_0201  [0201]
R21248  10K  RESISTOR_0201  [0201]
R21249  10K  RESISTOR_0201  [0201]
R21250  10K  RESISTOR_0201  [0201]
R21251  10K  RESISTOR_0201  [0201]
R21252  10K  RESISTOR_0201  [0201]
R21253  10K  RESISTOR_0201  [0201]
R21254  10K  RESISTOR_0201  [0201]
R21255  10K  RESISTOR_0201  [0201]
R21256  10K  RESISTOR_0201  [0201]
R21257  10K  RESISTOR_0201  [0201]
R21258  10K  RESISTOR_0201  [0201]
R21259  10K  RESISTOR_0201  [0201]
R21260  10K  RESISTOR_0201  [0201]
R21261  10K  RESISTOR_0201  [0201]
R21262  10K  RESISTOR_0201  [0201]
R21263  10K  RESISTOR_0201  [0201]
R21264  10K  RESISTOR_0201  [0201]
R21265  10K  RESISTOR_0201  [0201]
R21266  10K  RESISTOR_0201  [0201]
R21267  10K  RESISTOR_0201  [0201]
R21268  10K  RESISTOR_0201  [0201]
R21269  10K  RESISTOR_0201  [0201]
R21270  10K  RESISTOR_0201  [0201]
R21271  10K  RESISTOR_0201  [0201]
R21272  10K  RESISTOR_0201  [0201]
R21273  10K  RESISTOR_0201  [0201]
R21274  10K  RESISTOR_0201  [0201]
R21275  10K  RESISTOR_0201  [0201]
R21276  10K  RESISTOR_0201  [0201]
R21277  10K  RESISTOR_0201  [0201]
R21278  10K  RESISTOR_0201  [0201]
R21279  10K  RESISTOR_0201  [0201]
R21280  10K  RESISTOR_0201  [0201]
R21281  10K  RESISTOR_0201  [0201]
R21282  10K  RESISTOR_0201  [0201]
R21283  10K  RESISTOR_0201  [0201]
R21284  10K  RESISTOR_0201  [0201]
R21285  10K  RESISTOR_0201  [0201]
R21286  10K  RESISTOR_0201  [0201]
R21287  10K  RESISTOR_0201  [0201]
R21288  10K  RESISTOR_0201  [0201]
R21289  10K  RESISTOR_0201  [0201]
R21290  10K  RESISTOR_0201  [0201]
R21291  10K  RESISTOR_0201  [0201]
R21292  10K  RESISTOR_0201  [0201]
R21293  10K  RESISTOR_0201  [0201]
R21294  10K  RESISTOR_0201  [0201]
R21295  10K  RESISTOR_0201  [0201]
R21296  10K  RESISTOR_0201  [0201]
R21297  10K  RESISTOR_0201  [0201]
R21298  10K  RESISTOR_0201  [0201]
R21299  10K  RESISTOR_0201  [0201]
R21300  10K  RESISTOR_0201  [0201]
R21301  10K  RESISTOR_0201  [0201]
R21302  10K  RESISTOR_0201  [0201]
R21303  10K  RESISTOR_0201  [0201]
R21304  10K  RESISTOR_0201  [0201]
R21305  10K  RESISTOR_0201  [0201]
R21306  10K  RESISTOR_0201  [0201]
R21307  10K  RESISTOR_0201  [0201]
R21308  10K  RESISTOR_0201  [0201]
R21309  10K  RESISTOR_0201  [0201]
R21310  10K  RESISTOR_0201  [0201]
R21311  10K  RESISTOR_0201  [0201]
R21312  10K  RESISTOR_0201  [0201]
R21313  10K  RESISTOR_0201  [0201]
R21314  10K  RESISTOR_0201  [0201]
R21315  10K  RESISTOR_0201  [0201]
R21316  10K  RESISTOR_0201  [0201]
R21317  10K  RESISTOR_0201  [0201]
R21318  10K  RESISTOR_0201  [0201]
R21319  10K  RESISTOR_0201  [0201]
R21320  10K  RESISTOR_0201  [0201]
R21321  10K  RESISTOR_0201  [0201]
R21322  10K  RESISTOR_0201  [0201]
R21323  10K  RESISTOR_0201  [0201]
R21324  10K  RESISTOR_0201  [0201]
R21325  10K  RESISTOR_0201  [0201]
R21326  10K  RESISTOR_0201  [0201]
R21327  10K  RESISTOR_0201  [0201]
R21328  10K  RESISTOR_0201  [0201]
R21329  10K  RESISTOR_0201  [0201]
R21330  10K  RESISTOR_0201  [0201]
R21331  10K  RESISTOR_0201  [0201]
R21332  10K  RESISTOR_0201  [0201]
R21333  10K  RESISTOR_0201  [0201]
R21334  10K  RESISTOR_0201  [0201]
R21335  10K  RESISTOR_0201  [0201]
R21336  10K  RESISTOR_0201  [0201]
R21337  10K  RESISTOR_0201  [0201]
R21338  10K  RESISTOR_0201  [0201]
R21339  10K  RESISTOR_0201  [0201]
R21340  10K  RESISTOR_0201  [0201]
R21341  10K  RESISTOR_0201  [0201]
R21342  10K  RESISTOR_0201  [0201]
R21343  10K  RESISTOR_0201  [0201]
R21344  10K  RESISTOR_0201  [0201]
R21345  10K  RESISTOR_0201  [0201]
R21346  10K  RESISTOR_0201  [0201]
R21347  10K  RESISTOR_0201  [0201]
R21348  10K  RESISTOR_0201  [0201]
R21349  10K  RESISTOR_0201  [0201]
R21350  10K  RESISTOR_0201  [0201]
R21351  10K  RESISTOR_0201  [0201]
R21352  10K  RESISTOR_0201  [0201]
R21353  10K  RESISTOR_0201  [0201]
R21354  10K  RESISTOR_0201  [0201]
R21355  10K  RESISTOR_0201  [0201]
R21356  10K  RESISTOR_0201  [0201]
R21357  10K  RESISTOR_0201  [0201]
R21358  10K  RESISTOR_0201  [0201]
R21359  10K  RESISTOR_0201  [0201]
R21360  10K  RESISTOR_0201  [0201]
R21361  10K  RESISTOR_0201  [0201]
R21362  10K  RESISTOR_0201  [0201]
R21363  10K  RESISTOR_0201  [0201]
R21364  10K  RESISTOR_0201  [0201]
R21365  10K  RESISTOR_0201  [0201]
R21366  10K  RESISTOR_0201  [0201]
R21367  10K  RESISTOR_0201  [0201]
R21368  10K  RESISTOR_0201  [0201]
R21369  10K  RESISTOR_0201  [0201]
R21370  10K  RESISTOR_0201  [0201]
R21371  10K  RESISTOR_0201  [0201]
R21372  10K  RESISTOR_0201  [0201]
R21373  10K  RESISTOR_0201  [0201]
R21374  10K  RESISTOR_0201  [0201]
R21375  10K  RESISTOR_0201  [0201]
R21376  10K  RESISTOR_0201  [0201]
R21377  10K  RESISTOR_0201  [0201]
R21378  10K  RESISTOR_0201  [0201]
R21379  10K  RESISTOR_0201  [0201]
R21380  10K  RESISTOR_0201  [0201]
R21381  10K  RESISTOR_0201  [0201]
R21382  10K  RESISTOR_0201  [0201]
R21383  10K  RESISTOR_0201  [0201]
R21384  10K  RESISTOR_0201  [0201]
R21385  10K  RESISTOR_0201  [0201]
R21386  10K  RESISTOR_0201  [0201]
R21387  10K  RESISTOR_0201  [0201]
R21388  10K  RESISTOR_0201  [0201]
R21389  10K  RESISTOR_0201  [0201]
R21390  10K  RESISTOR_0201  [0201]
R21391  10K  RESISTOR_0201  [0201]
R21392  10K  RESISTOR_0201  [0201]
R21393  10K  RESISTOR_0201  [0201]
R21394  10K  RESISTOR_0201  [0201]
R21395  10K  RESISTOR_0201  [0201]
R21396  10K  RESISTOR_0201  [0201]
R21397  10K  RESISTOR_0201  [0201]
R21398  10K  RESISTOR_0201  [0201]
R21399  10K  RESISTOR_0201  [0201]
R21400  10K  RESISTOR_0201  [0201]
R21401  10K  RESISTOR_0201  [0201]
R21402  10K  RESISTOR_0201  [0201]
R21403  10K  RESISTOR_0201  [0201]
R21404  10K  RESISTOR_0201  [0201]
R21405  10K  RESISTOR_0201  [0201]
R21406  10K  RESISTOR_0201  [0201]
R21407  10K  RESISTOR_0201  [0201]
R21408  10K  RESISTOR_0201  [0201]
R21409  10K  RESISTOR_0201  [0201]
R21410  10K  RESISTOR_0201  [0201]
R21411  10K  RESISTOR_0201  [0201]
R21412  10K  RESISTOR_0201  [0201]
R21413  10K  RESISTOR_0201  [0201]
R21414  10K  RESISTOR_0201  [0201]
R21415  10K  RESISTOR_0201  [0201]
R21416  10K  RESISTOR_0201  [0201]
R21417  10K  RESISTOR_0201  [0201]
R21418  10K  RESISTOR_0201  [0201]
R21419  10K  RESISTOR_0201  [0201]
R21420  10K  RESISTOR_0201  [0201]
R21421  10K  RESISTOR_0201  [0201]
R21422  10K  RESISTOR_0201  [0201]
R21423  10K  RESISTOR_0201  [0201]
R21424  10K  RESISTOR_0201  [0201]
R21425  10K  RESISTOR_0201  [0201]
R21426  10K  RESISTOR_0201  [0201]
R21427  10K  RESISTOR_0201  [0201]
R21428  10K  RESISTOR_0201  [0201]
R21429  10K  RESISTOR_0201  [0201]
R21430  10K  RESISTOR_0201  [0201]
R21431  10K  RESISTOR_0201  [0201]
R21432  10K  RESISTOR_0201  [0201]
R21433  10K  RESISTOR_0201  [0201]
R21434  10K  RESISTOR_0201  [0201]
R21435  10K  RESISTOR_0201  [0201]
R21436  10K  RESISTOR_0201  [0201]
R21437  10K  RESISTOR_0201  [0201]
R21438  10K  RESISTOR_0201  [0201]
R21439  10K  RESISTOR_0201  [0201]
R21440  10K  RESISTOR_0201  [0201]
R21441  10K  RESISTOR_0201  [0201]
R21442  10K  RESISTOR_0201  [0201]
R21443  10K  RESISTOR_0201  [0201]
R21444  10K  RESISTOR_0201  [0201]
R21445  10K  RESISTOR_0201  [0201]
R21446  10K  RESISTOR_0201  [0201]
R21447  10K  RESISTOR_0201  [0201]
R21448  10K  RESISTOR_0201  [0201]
R21449  10K  RESISTOR_0201  [0201]
R21450  10K  RESISTOR_0201  [0201]
R21451  10K  RESISTOR_0201  [0201]
R21452  10K  RESISTOR_0201  [0201]
R21453  10K  RESISTOR_0201  [0201]
R21454  10K  RESISTOR_0201  [0201]
R21455  10K  RESISTOR_0201  [0201]
R21456  10K  RESISTOR_0201  [0201]
R21457  10K  RESISTOR_0201  [0201]
R21458  10K  RESISTOR_0201  [0201]
R21459  10K  RESISTOR_0201  [0201]
R21460  10K  RESISTOR_0201  [0201]
R21461  10K  RESISTOR_0201  [0201]
R21462  10K  RESISTOR_0201  [0201]
R21463  10K  RESISTOR_0201  [0201]
R21464  10K  RESISTOR_0201  [0201]
R21465  10K  RESISTOR_0201  [0201]
R21466  10K  RESISTOR_0201  [0201]
R21467  10K  RESISTOR_0201  [0201]
R21468  10K  RESISTOR_0201  [0201]
R21469  10K  RESISTOR_0201  [0201]
R21470  10K  RESISTOR_0201  [0201]
R21471  10K  RESISTOR_0201  [0201]
R21472  10K  RESISTOR_0201  [0201]
R21473  10K  RESISTOR_0201  [0201]
R21474  10K  RESISTOR_0201  [0201]
R21475  10K  RESISTOR_0201  [0201]
R21476  10K  RESISTOR_0201  [0201]
R21477  10K  RESISTOR_0201  [0201]
R21478  10K  RESISTOR_0201  [0201]
R21479  10K  RESISTOR_0201  [0201]
R21480  10K  RESISTOR_0201  [0201]
R21481  10K  RESISTOR_0201  [0201]
R21482  10K  RESISTOR_0201  [0201]
R21483  10K  RESISTOR_0201  [0201]
R21484  10K  RESISTOR_0201  [0201]
R21485  10K  RESISTOR_0201  [0201]
R21486  10K  RESISTOR_0201  [0201]
R21487  10K  RESISTOR_0201  [0201]
R21488  10K  RESISTOR_0201  [0201]
R21489  10K  RESISTOR_0201  [0201]
R21490  10K  RESISTOR_0201  [0201]
R21491  10K  RESISTOR_0201  [0201]
R21492  10K  RESISTOR_0201  [0201]
R21493  10K  RESISTOR_0201  [0201]
R21494  10K  RESISTOR_0201  [0201]
R21495  10K  RESISTOR_0201  [0201]
R21496  10K  RESISTOR_0201  [0201]
R21497  10K  RESISTOR_0201  [0201]
R21498  10K  RESISTOR_0201  [0201]
R21499  10K  RESISTOR_0201  [0201]
R21500  10K  RESISTOR_0201  [0201]
R21501  10K  RESISTOR_0201  [0201]
R21502  10K  RESISTOR_0201  [0201]
R21503  10K  RESISTOR_0201  [0201]
R21504  10K  RESISTOR_0201  [0201]
R21505  10K  RESISTOR_0201  [0201]
R21506  10K  RESISTOR_0201  [0201]
R21507  10K  RESISTOR_0201  [0201]
R21508  10K  RESISTOR_0201  [0201]
R21509  10K  RESISTOR_0201  [0201]
R21510  10K  RESISTOR_0201  [0201]
R21511  10K  RESISTOR_0201  [0201]
R21512  10K  RESISTOR_0201  [0201]
R21513  10K  RESISTOR_0201  [0201]
R21514  10K  RESISTOR_0201  [0201]
R21515  10K  RESISTOR_0201  [0201]
R21516  10K  RESISTOR_0201  [0201]
R21517  10K  RESISTOR_0201  [0201]
R21518  10K  RESISTOR_0201  [0201]
R21519  10K  RESISTOR_0201  [0201]
R21520  10K  RESISTOR_0201  [0201]
R21521  10K  RESISTOR_0201  [0201]
R21522  10K  RESISTOR_0201  [0201]
R21523  10K  RESISTOR_0201  [0201]
R21524  10K  RESISTOR_0201  [0201]
R21525  10K  RESISTOR_0201  [0201]
R21526  10K  RESISTOR_0201  [0201]
R21527  10K  RESISTOR_0201  [0201]
R21528  10K  RESISTOR_0201  [0201]
R21529  10K  RESISTOR_0201  [0201]
R21530  10K  RESISTOR_0201  [0201]
R21531  10K  RESISTOR_0201  [0201]
R21532  10K  RESISTOR_0201  [0201]
R21533  10K  RESISTOR_0201  [0201]
R21534  10K  RESISTOR_0201  [0201]
R21535  10K  RESISTOR_0201  [0201]
R21536  10K  RESISTOR_0201  [0201]
R21537  10K  RESISTOR_0201  [0201]
R21538  10K  RESISTOR_0201  [0201]
R21539  10K  RESISTOR_0201  [0201]
R21540  10K  RESISTOR_0201  [0201]
R21541  10K  RESISTOR_0201  [0201]
R21542  10K  RESISTOR_0201  [0201]
R21543  10K  RESISTOR_0201  [0201]
R21544  10K  RESISTOR_0201  [0201]
R21545  10K  RESISTOR_0201  [0201]
R21546  10K  RESISTOR_0201  [0201]
R21547  10K  RESISTOR_0201  [0201]
R21548  10K  RESISTOR_0201  [0201]
R21549  10K  RESISTOR_0201  [0201]
R21550  10K  RESISTOR_0201  [0201]
R21551  10K  RESISTOR_0201  [0201]
R21552  10K  RESISTOR_0201  [0201]
R21553  10K  RESISTOR_0201  [0201]
R21554  10K  RESISTOR_0201  [0201]
R21555  10K  RESISTOR_0201  [0201]
R21556  10K  RESISTOR_0201  [0201]
R21557  10K  RESISTOR_0201  [0201]
R21558  10K  RESISTOR_0201  [0201]
R21559  10K  RESISTOR_0201  [0201]
R21560  10K  RESISTOR_0201  [0201]
R21561  10K  RESISTOR_0201  [0201]
R21562  10K  RESISTOR_0201  [0201]
R21563  10K  RESISTOR_0201  [0201]
R21564  10K  RESISTOR_0201  [0201]
R21565  10K  RESISTOR_0201  [0201]
R21566  10K  RESISTOR_0201  [0201]
R21567  10K  RESISTOR_0201  [0201]
R21568  10K  RESISTOR_0201  [0201]
R21569  10K  RESISTOR_0201  [0201]
R21570  10K  RESISTOR_0201  [0201]
R21571  10K  RESISTOR_0201  [0201]
R21572  10K  RESISTOR_0201  [0201]
R21573  10K  RESISTOR_0201  [0201]
R21574  10K  RESISTOR_0201  [0201]
R21575  10K  RESISTOR_0201  [0201]
R21576  10K  RESISTOR_0201  [0201]
R21577  10K  RESISTOR_0201  [0201]
R21578  10K  RESISTOR_0201  [0201]
R21579  10K  RESISTOR_0201  [0201]
R21580  10K  RESISTOR_0201  [0201]
R21581  10K  RESISTOR_0201  [0201]
R21582  10K  RESISTOR_0201  [0201]
R21583  10K  RESISTOR_0201  [0201]
R21584  10K  RESISTOR_0201  [0201]
R21585  10K  RESISTOR_0201  [0201]
R21586  10K  RESISTOR_0201  [0201]
R21587  10K  RESISTOR_0201  [0201]
R21588  10K  RESISTOR_0201  [0201]
R21589  10K  RESISTOR_0201  [0201]
R21590  10K  RESISTOR_0201  [0201]
R21591  10K  RESISTOR_0201  [0201]
R21592  10K  RESISTOR_0201  [0201]
R21593  10K  RESISTOR_0201  [0201]
R21594  10K  RESISTOR_0201  [0201]
R21595  10K  RESISTOR_0201  [0201]
R21596  10K  RESISTOR_0201  [0201]
R21597  10K  RESISTOR_0201  [0201]